# EasyEDA Pro project kuafu01_030内部老化方案.eprj, board PCB4 (continued)
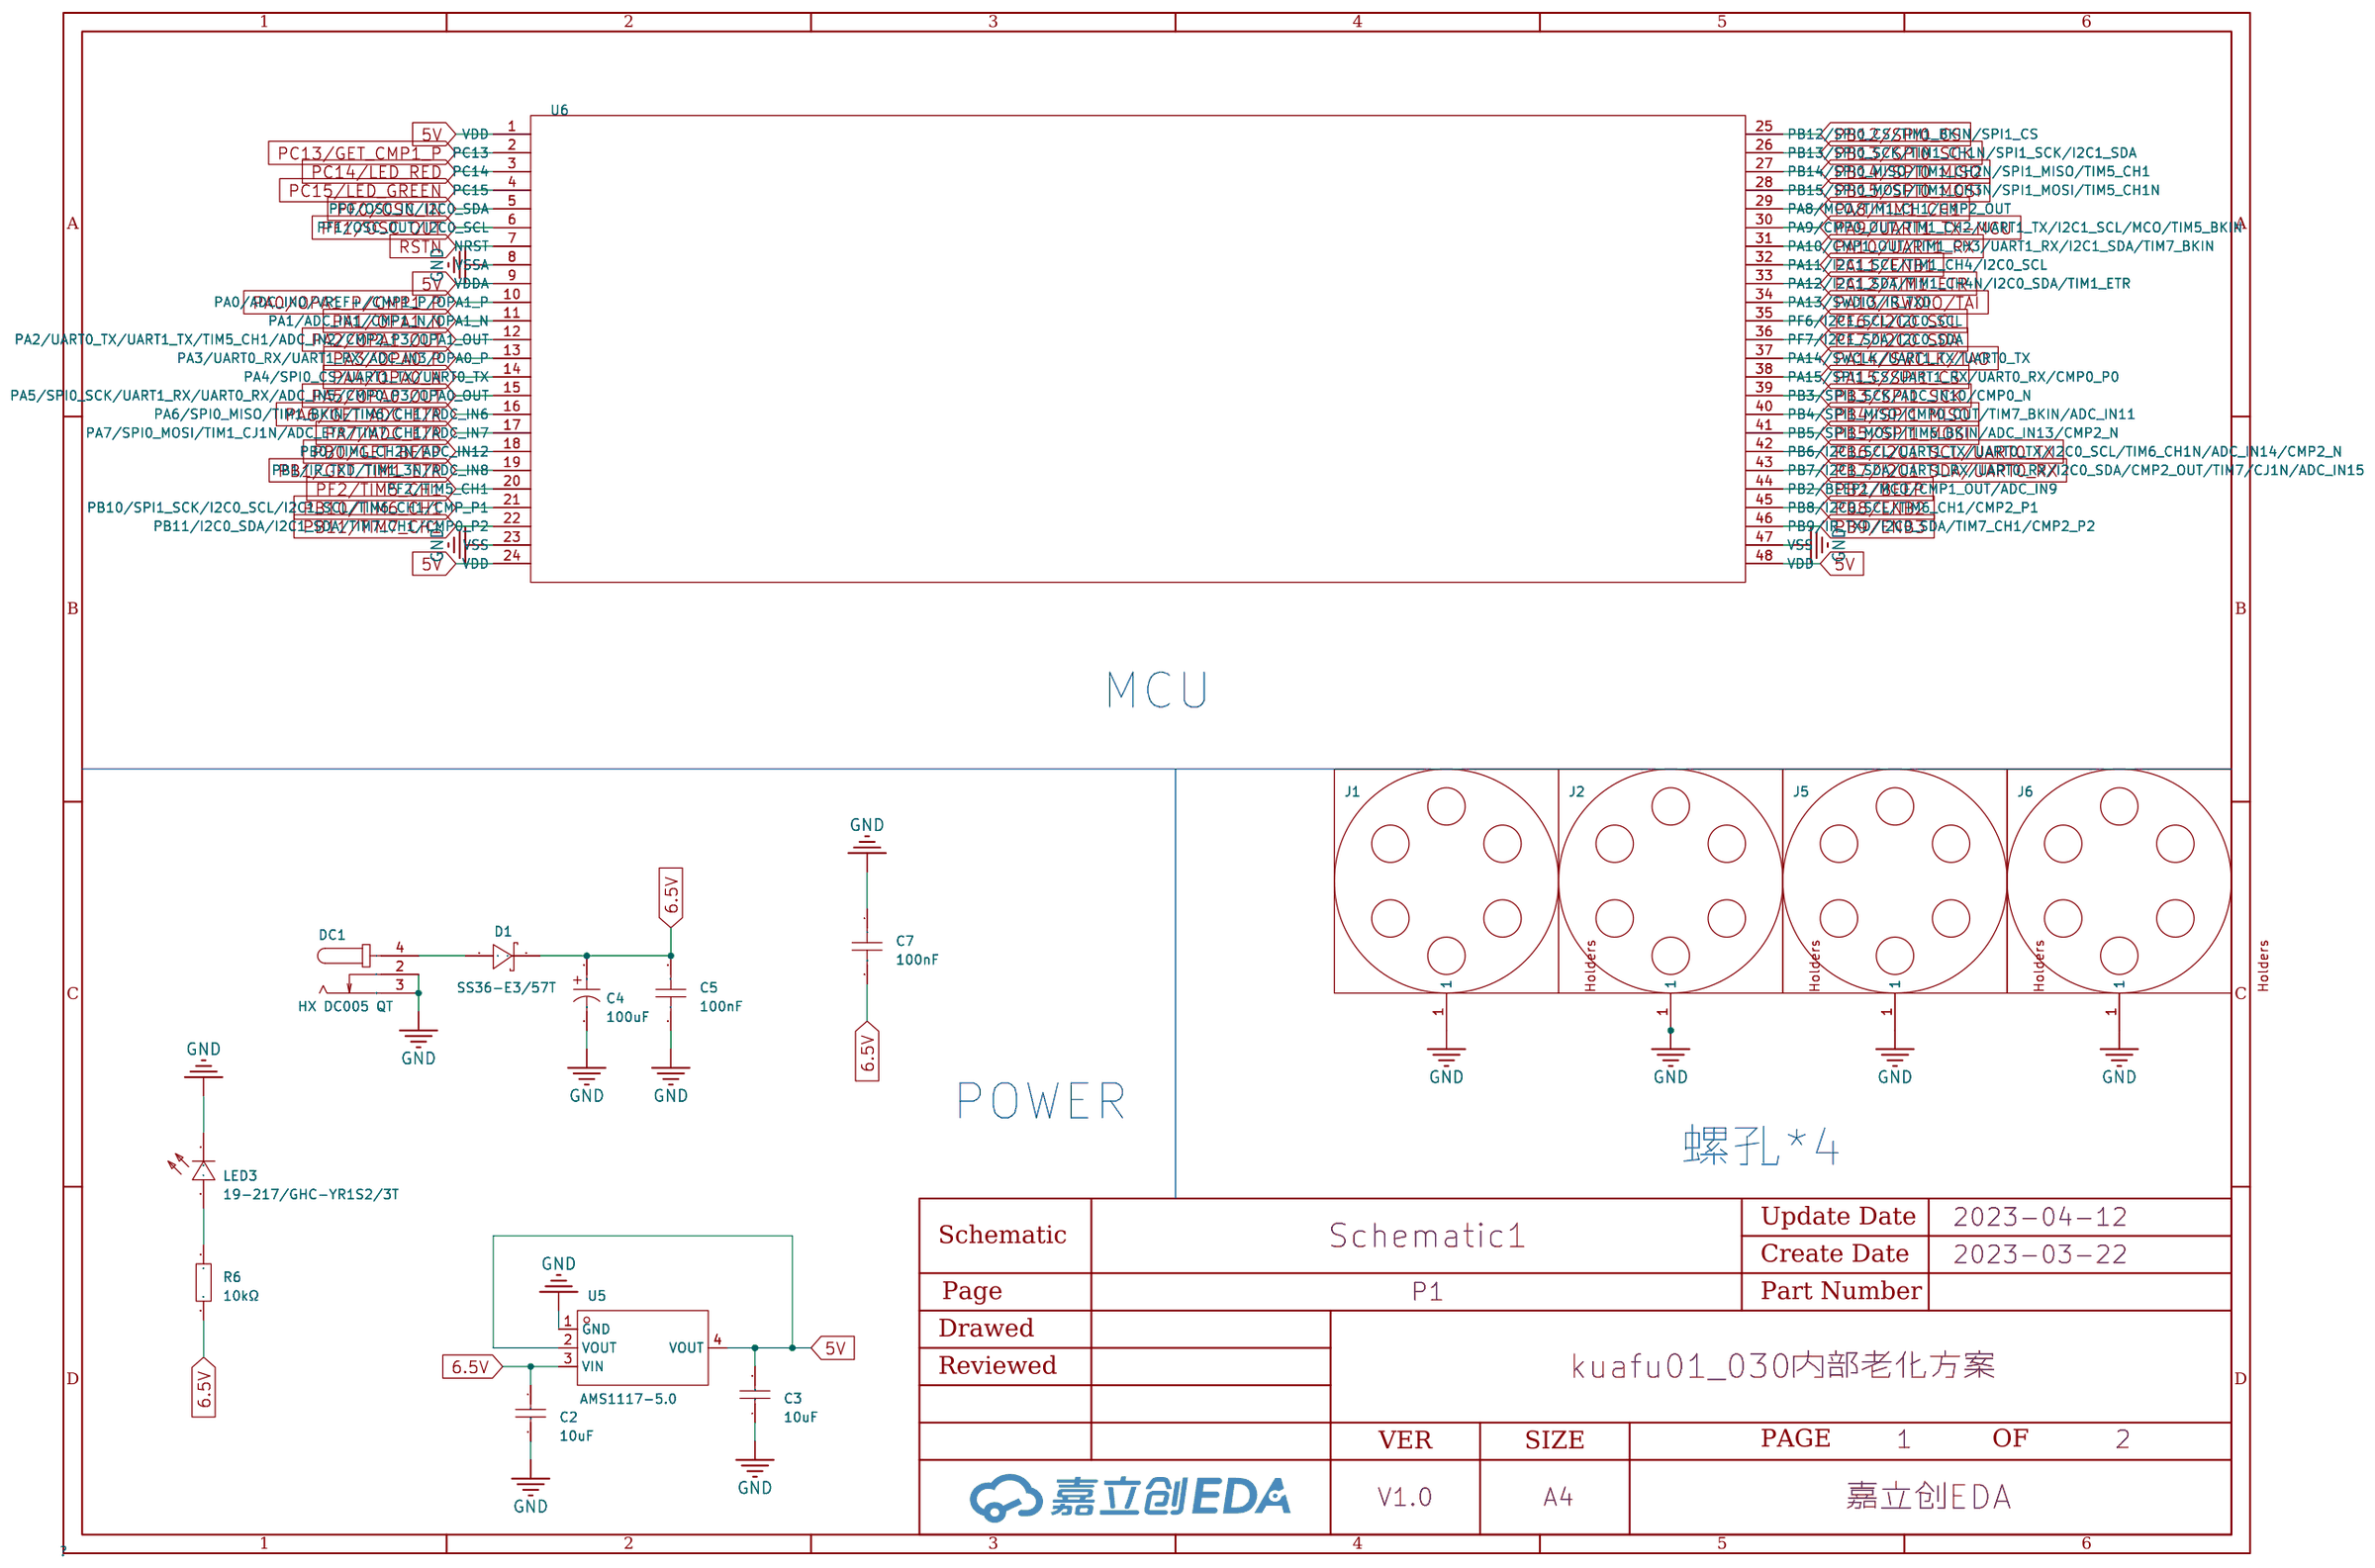
[diagram p0: P1]
## Routing (per net, layer and track width the routed paths; a pad name or vN(x,y) marks a point on that pad's centre or on a via; arc(x,y) is an arc through that point) (continued)
v1(113.79,267.46) v1(113.79,266.7) v1(113.79,256.54) v1(113.79,255.78) v1(113.79,255.02) v1(113.79,217.42) v1(113.79,216.66) v1(113.79,215.9) v1(113.79,205.74) v1(113.79,204.98) v1(113.79,204.22) v1(113.79,166.62) v1(113.79,165.86) v1(113.79,165.1) v1(113.79,154.94) v1(113.79,154.18) v1(113.79,153.42) v1(113.79,115.82) v1(113.79,115.06) v1(113.79,114.3) v1(113.79,104.14) v1(113.79,103.38) v1(113.79,102.62) v1(113.79,65.02) v1(113.79,64.26) v1(113.79,63.5) v1(113.79,53.34) v1(113.79,52.58) v1(113.79,51.82) v1(113.79,14.22) v1(113.79,13.46) v1(113.79,12.7) v1(114.55,358.14) v1(114.55,357.38) v1(114.55,356.62) v1(114.55,319.02) v1(114.55,318.26) v1(114.55,317.5) v1(114.55,307.34) v1(114.55,306.58) v1(114.55,305.82) v1(114.55,268.22) v1(114.55,267.46) v1(114.55,266.7) v1(114.55,256.54) v1(114.55,255.78) v1(114.55,255.02) v1(114.55,217.42) v1(114.55,216.66) v1(114.55,215.9) v1(114.55,205.74) v1(114.55,204.98) v1(114.55,204.22) v1(114.55,166.62) v1(114.55,165.86) v1(114.55,165.1) v1(114.55,154.94) v1(114.55,154.18) v1(114.55,153.42) v1(114.55,115.82) v1(114.55,115.06) v1(114.55,114.3) v1(114.55,104.14) v1(114.55,103.38) v1(114.55,102.62) v1(114.55,65.02) v1(114.55,64.26) v1(114.55,63.5) v1(114.55,53.34) v1(114.55,52.58) v1(114.55,51.82) v1(114.55,14.22) v1(114.55,13.46) v1(114.55,12.7) v1(115.32,358.14) v1(115.32,357.38) v1(115.32,356.62) v1(115.32,319.02) v1(115.32,318.26) v1(115.32,317.5) v1(115.32,307.34) v1(115.32,306.58) v1(115.32,305.82) v1(115.32,268.22) v1(115.32,267.46) v1(115.32,266.7) v1(115.32,256.54) v1(115.32,255.78) v1(115.32,255.02) v1(115.32,217.42) v1(115.32,216.66) v1(115.32,215.9) v1(115.32,205.74) v1(115.32,204.98) v1(115.32,204.22) v1(115.32,166.62) v1(115.32,165.86) v1(115.32,165.1) v1(115.32,154.94) v1(115.32,154.18) v1(115.32,153.42) v1(115.32,115.82) v1(115.32,115.06) v1(115.32,114.3) v1(115.32,104.14) v1(115.32,103.38) v1(115.32,102.62) v1(115.32,65.02) v1(115.32,64.26) v1(115.32,63.5) v1(115.32,53.34) v1(115.32,52.58) v1(115.32,51.82) v1(115.32,14.22) v1(115.32,13.46) v1(115.32,12.7) v1(116.33,352.04) v1(116.33,351.28) v1(116.33,350.52) v1(116.33,301.24) v1(116.33,300.48) v1(116.33,299.72) v1(116.33,250.44) v1(116.33,249.68) v1(116.33,248.92) v1(116.33,199.64) v1(116.33,198.88) v1(116.33,198.12) v1(116.33,148.84) v1(116.33,148.08) v1(116.33,147.32) v1(116.33,98.04) v1(116.33,97.28) v1(116.33,96.52) v1(116.33,47.24) v1(116.33,46.48) v1(116.33,45.72) v1(117.09,352.04) v1(117.09,351.28) v1(117.09,350.52) v1(117.09,301.24) v1(117.09,300.48) v1(117.09,299.72) v1(117.09,250.44) v1(117.09,249.68) v1(117.09,248.92) v1(117.09,199.64) v1(117.09,198.88) v1(117.09,198.12) v1(117.09,148.84) v1(117.09,148.08) v1(117.09,147.32) v1(117.09,98.04) v1(117.09,97.28) v1(117.09,96.52) v1(117.09,47.24) v1(117.09,46.48) v1(117.09,45.72) v1(117.86,352.04) v1(117.86,351.28) v1(117.86,350.52) v1(117.86,301.24) v1(117.86,300.48) v1(117.86,299.72) v1(117.86,250.44) v1(117.86,249.68) v1(117.86,248.92) v1(117.86,199.64) v1(117.86,198.88) v1(117.86,198.12) v1(117.86,148.84) v1(117.86,148.08) v1(117.86,147.32) v1(117.86,98.04) v1(117.86,97.28) v1(117.86,96.52) v1(117.86,47.24) v1(117.86,46.48) v1(117.86,45.72) v1(119.38,345.95) v1(119.38,345.19) v1(119.38,344.42) v1(119.38,323.6) v1(119.38,322.83) v1(119.38,322.07) v1(119.38,295.15) v1(119.38,294.39) v1(119.38,293.62) v1(119.38,272.8) v1(119.38,272.03) v1(119.38,271.27) v1(119.38,244.35) v1(119.38,243.59) v1(119.38,242.82) v1(119.38,222) v1(119.38,221.23) v1(119.38,220.47) v1(119.38,193.55) v1(119.38,192.79) v1(119.38,192.02) v1(119.38,171.2) v1(119.38,170.43) v1(119.38,169.67) v1(119.38,142.75) v1(119.38,141.99) v1(119.38,141.22) v1(119.38,120.4) v1(119.38,119.63) v1(119.38,118.87) v1(119.38,91.95) v1(119.38,91.19) v1(119.38,90.42) v1(119.38,69.6) v1(119.38,68.83) v1(119.38,68.07) v1(119.38,41.15) v1(119.38,40.39) v1(119.38,39.62) v1(119.38,18.8) v1(119.38,18.03) v1(119.38,17.27) v1(120.14,345.95) v1(120.14,345.19) v1(120.14,344.42) v1(120.14,323.6) v1(120.14,322.83) v1(120.14,322.07) v1(120.14,295.15) v1(120.14,294.39) v1(120.14,293.62) v1(120.14,272.8) v1(120.14,272.03) v1(120.14,271.27) v1(120.14,244.35) v1(120.14,243.59) v1(120.14,242.82) v1(120.14,222) v1(120.14,221.23) v1(120.14,220.47) v1(120.14,193.55) v1(120.14,192.79) v1(120.14,192.02) v1(120.14,171.2) v1(120.14,170.43) v1(120.14,169.67) v1(120.14,142.75) v1(120.14,141.99) v1(120.14,141.22) v1(120.14,120.4) v1(120.14,119.63) v1(120.14,118.87) v1(120.14,91.95) v1(120.14,91.19) v1(120.14,90.42) v1(120.14,69.6) v1(120.14,68.83) v1(120.14,68.07) v1(120.14,41.15) v1(120.14,40.39) v1(120.14,39.62) v1(120.14,18.8) v1(120.14,18.03) v1(120.14,17.27) v1(120.9,345.95) v1(120.9,345.19) v1(120.9,344.42) v1(120.9,323.6) v1(120.9,322.83) v1(120.9,322.07) v1(120.9,295.15) v1(120.9,294.39) v1(120.9,293.62) v1(120.9,272.8) v1(120.9,272.03) v1(120.9,271.27) v1(120.9,244.35) v1(120.9,243.59) v1(120.9,242.82) v1(120.9,222) v1(120.9,221.23) v1(120.9,220.47) v1(120.9,193.55) v1(120.9,192.79) v1(120.9,192.02) v1(120.9,171.2) v1(120.9,170.43) v1(120.9,169.67) v1(120.9,142.75) v1(120.9,141.99) v1(120.9,141.22) v1(120.9,120.4) v1(120.9,119.63) v1(120.9,118.87) v1(120.9,91.95) v1(120.9,91.19) v1(120.9,90.42) v1(120.9,69.6) v1(120.9,68.83) v1(120.9,68.07) v1(120.9,41.15) v1(120.9,40.39) v1(120.9,39.62) v1(120.9,18.8) v1(120.9,18.03) v1(120.9,17.27) v1(122.43,338.84) v1(122.43,338.07) v1(122.43,337.31) v1(122.43,329.18) v1(122.43,328.42) v1(122.43,327.66) v1(122.43,288.04) v1(122.43,287.27) v1(122.43,286.51) v1(122.43,278.38) v1(122.43,277.62) v1(122.43,276.86) v1(122.43,237.24) v1(122.43,236.47) v1(122.43,235.71) v1(122.43,227.58) v1(122.43,226.82) v1(122.43,226.06) v1(122.43,186.44) v1(122.43,185.67) v1(122.43,184.91) v1(122.43,176.78) v1(122.43,176.02) v1(122.43,175.26) v1(122.43,135.64) v1(122.43,134.87) v1(122.43,134.11) v1(122.43,125.98) v1(122.43,125.22) v1(122.43,124.46) v1(122.43,84.84) v1(122.43,84.07) v1(122.43,83.31) v1(122.43,75.18) v1(122.43,74.42) v1(122.43,73.66) v1(122.43,34.04) v1(122.43,33.27) v1(122.43,32.51) v1(122.43,24.38) v1(122.43,23.62) v1(122.43,22.86) v1(123.19,338.84) v1(123.19,338.07) v1(123.19,337.31) v1(123.19,329.18) v1(123.19,328.42) v1(123.19,327.66) v1(123.19,288.04) v1(123.19,287.27) v1(123.19,286.51) v1(123.19,278.38) v1(123.19,277.62) v1(123.19,276.86) v1(123.19,237.24) v1(123.19,236.47) v1(123.19,235.71) v1(123.19,227.58) v1(123.19,226.82) v1(123.19,226.06) v1(123.19,186.44) v1(123.19,185.67) v1(123.19,184.91) v1(123.19,176.78) v1(123.19,176.02) v1(123.19,175.26) v1(123.19,135.64) v1(123.19,134.87) v1(123.19,134.11) v1(123.19,125.98) v1(123.19,125.22) v1(123.19,124.46) v1(123.19,84.84) v1(123.19,84.07) v1(123.19,83.31) v1(123.19,75.18) v1(123.19,74.42) v1(123.19,73.66) v1(123.19,34.04) v1(123.19,33.27) v1(123.19,32.51) v1(123.19,24.38) v1(123.19,23.62) v1(123.19,22.86) v1(123.95,338.84) v1(123.95,338.07) v1(123.95,337.31) v1(123.95,329.18) v1(123.95,328.42) v1(123.95,327.66) v1(123.95,288.04) v1(123.95,287.27) v1(123.95,286.51) v1(123.95,278.38) v1(123.95,277.62) v1(123.95,276.86) v1(123.95,237.24) v1(123.95,236.47) v1(123.95,235.71) v1(123.95,227.58) v1(123.95,226.82) v1(123.95,226.06) v1(123.95,186.44) v1(123.95,185.67) v1(123.95,184.91) v1(123.95,176.78) v1(123.95,176.02) v1(123.95,175.26) v1(123.95,135.64) v1(123.95,134.87) v1(123.95,134.11) v1(123.95,125.98) v1(123.95,125.22) v1(123.95,124.46) v1(123.95,84.84) v1(123.95,84.07) v1(123.95,83.31) v1(123.95,75.18) v1(123.95,74.42) v1(123.95,73.66) v1(123.95,34.04) v1(123.95,33.27) v1(123.95,32.51) v1(123.95,24.38) v1(123.95,23.62) v1(123.95,22.86) v1(129.03,338.84) v1(129.03,338.07) v1(129.03,337.31) v1(129.03,332.74) v1(129.03,331.98) v1(129.03,331.22) v1(129.03,325.12) v1(129.03,324.36) v1(129.03,323.6) v1(129.03,288.04) v1(129.03,287.27) v1(129.03,286.51) v1(129.03,281.94) v1(129.03,281.18) v1(129.03,280.42) v1(129.03,274.32) v1(129.03,273.56) v1(129.03,272.8) v1(129.03,237.24) v1(129.03,236.47) v1(129.03,235.71) v1(129.03,231.14) v1(129.03,230.38) v1(129.03,229.62) v1(129.03,223.52) v1(129.03,222.76) v1(129.03,222) v1(129.03,186.44) v1(129.03,185.67) v1(129.03,184.91) v1(129.03,180.34) v1(129.03,179.58) v1(129.03,178.82) v1(129.03,172.72) v1(129.03,171.96) v1(129.03,171.2) v1(129.03,135.64) v1(129.03,134.87) v1(129.03,134.11) v1(129.03,129.54) v1(129.03,128.78) v1(129.03,128.02) v1(129.03,121.92) v1(129.03,121.16) v1(129.03,120.4) v1(129.03,84.84) v1(129.03,84.07) v1(129.03,83.31) v1(129.03,78.74) v1(129.03,77.98) v1(129.03,77.22) v1(129.03,71.12) v1(129.03,70.36) v1(129.03,69.6) v1(129.03,34.04) v1(129.03,33.27) v1(129.03,32.51) v1(129.03,27.94) v1(129.03,27.18) v1(129.03,26.42) v1(129.03,20.32) v1(129.03,19.56) v1(129.03,18.8) v1(129.79,338.84) v1(129.79,338.07) v1(129.79,337.31) v1(129.79,332.74) v1(129.79,331.98) v1(129.79,331.22) v1(129.79,325.12) v1(129.79,324.36) v1(129.79,323.6) v1(129.79,288.04) v1(129.79,287.27) v1(129.79,286.51) v1(129.79,281.94) v1(129.79,281.18) v1(129.79,280.42) v1(129.79,274.32) v1(129.79,273.56) v1(129.79,272.8) v1(129.79,237.24) v1(129.79,236.47) v1(129.79,235.71) v1(129.79,231.14) v1(129.79,230.38) v1(129.79,229.62) v1(129.79,223.52) v1(129.79,222.76) v1(129.79,222) v1(129.79,186.44) v1(129.79,185.67) v1(129.79,184.91) v1(129.79,180.34) v1(129.79,179.58) v1(129.79,178.82) v1(129.79,172.72) v1(129.79,171.96) v1(129.79,171.2) v1(129.79,135.64) v1(129.79,134.87) v1(129.79,134.11) v1(129.79,129.54) v1(129.79,128.78) v1(129.79,128.02) v1(129.79,121.92) v1(129.79,121.16) v1(129.79,120.4) v1(129.79,84.84) v1(129.79,84.07) v1(129.79,83.31) v1(129.79,78.74) v1(129.79,77.98) v1(129.79,77.22) v1(129.79,71.12) v1(129.79,70.36) v1(129.79,69.6) v1(129.79,34.04) v1(129.79,33.27) v1(129.79,32.51) v1(129.79,27.94) v1(129.79,27.18) v1(129.79,26.42) v1(129.79,20.32) v1(129.79,19.56) v1(129.79,18.8) v1(130.56,338.84) v1(130.56,338.07) v1(130.56,337.31) v1(130.56,332.74) v1(130.56,331.98) v1(130.56,331.22) v1(130.56,325.12) v1(130.56,324.36) v1(130.56,323.6) v1(130.56,288.04) v1(130.56,287.27) v1(130.56,286.51) v1(130.56,281.94) v1(130.56,281.18) v1(130.56,280.42) v1(130.56,274.32) v1(130.56,273.56) v1(130.56,272.8) v1(130.56,237.24) v1(130.56,236.47) v1(130.56,235.71) v1(130.56,231.14) v1(130.56,230.38) v1(130.56,229.62) v1(130.56,223.52) v1(130.56,222.76) v1(130.56,222) v1(130.56,186.44) v1(130.56,185.67) v1(130.56,184.91) v1(130.56,180.34) v1(130.56,179.58) v1(130.56,178.82) v1(130.56,172.72) v1(130.56,171.96) v1(130.56,171.2) v1(130.56,135.64) v1(130.56,134.87) v1(130.56,134.11) v1(130.56,129.54) v1(130.56,128.78) v1(130.56,128.02) v1(130.56,121.92) v1(130.56,121.16) v1(130.56,120.4) v1(130.56,84.84) v1(130.56,84.07) v1(130.56,83.31) v1(130.56,78.74) v1(130.56,77.98) v1(130.56,77.22) v1(130.56,71.12) v1(130.56,70.36) v1(130.56,69.6) v1(130.56,34.04) v1(130.56,33.27) v1(130.56,32.51) v1(130.56,27.94) v1(130.56,27.18) v1(130.56,26.42) v1(130.56,20.32) v1(130.56,19.56) v1(130.56,18.8) v1(131.06,345.95) v1(131.06,345.19) v1(131.06,344.42) v1(131.06,295.15) v1(131.06,294.39) v1(131.06,293.62) v1(131.06,244.35) v1(131.06,243.59) v1(131.06,242.82) v1(131.06,193.55) v1(131.06,192.79) v1(131.06,192.02) v1(131.06,142.75) v1(131.06,141.99) v1(131.06,141.22) v1(131.06,91.95) v1(131.06,91.19) v1(131.06,90.42) v1(131.06,41.15) v1(131.06,40.39) v1(131.06,39.62) v1(131.83,345.95) v1(131.83,345.19) v1(131.83,344.42) v1(131.83,295.15) v1(131.83,294.39) v1(131.83,293.62) v1(131.83,244.35) v1(131.83,243.59) v1(131.83,242.82) v1(131.83,193.55) v1(131.83,192.79) v1(131.83,192.02) v1(131.83,142.75) v1(131.83,141.99) v1(131.83,141.22) v1(131.83,91.95) v1(131.83,91.19) v1(131.83,90.42) v1(131.83,41.15) v1(131.83,40.39) v1(131.83,39.62) v1(132.59,352.04) v1(132.59,351.28) v1(132.59,350.52) v1(132.59,345.95) v1(132.59,345.19) v1(132.59,344.42) v1(132.59,301.24) v1(132.59,300.48) v1(132.59,299.72) v1(132.59,295.15) v1(132.59,294.39) v1(132.59,293.62) v1(132.59,250.44) v1(132.59,249.68) v1(132.59,248.92) v1(132.59,244.35) v1(132.59,243.59) v1(132.59,242.82) v1(132.59,199.64) v1(132.59,198.88) v1(132.59,198.12) v1(132.59,193.55) v1(132.59,192.79) v1(132.59,192.02) v1(132.59,148.84) v1(132.59,148.08) v1(132.59,147.32) v1(132.59,142.75) v1(132.59,141.99) v1(132.59,141.22) v1(132.59,98.04) v1(132.59,97.28) v1(132.59,96.52) v1(132.59,91.95) v1(132.59,91.19) v1(132.59,90.42) v1(132.59,47.24) v1(132.59,46.48) v1(132.59,45.72) v1(132.59,41.15) v1(132.59,40.39) v1(132.59,39.62) v1(133.35,352.04) v1(133.35,351.28) v1(133.35,350.52) v1(133.35,301.24) v1(133.35,300.48) v1(133.35,299.72) v1(133.35,250.44) v1(133.35,249.68) v1(133.35,248.92) v1(133.35,199.64) v1(133.35,198.88) v1(133.35,198.12) v1(133.35,148.84) v1(133.35,148.08) v1(133.35,147.32) v1(133.35,98.04) v1(133.35,97.28) v1(133.35,96.52) v1(133.35,47.24) v1(133.35,46.48) v1(133.35,45.72) v1(134.11,352.04) v1(134.11,351.28) v1(134.11,350.52) v1(134.11,301.24) v1(134.11,300.48) v1(134.11,299.72) v1(134.11,250.44) v1(134.11,249.68) v1(134.11,248.92) v1(134.11,199.64) v1(134.11,198.88) v1(134.11,198.12) v1(134.11,148.84) v1(134.11,148.08) v1(134.11,147.32) v1(134.11,98.04) v1(134.11,97.28) v1(134.11,96.52) v1(134.11,47.24) v1(134.11,46.48) v1(134.11,45.72) v1(134.62,358.14) v1(134.62,357.38) v1(134.62,356.62) v1(134.62,319.02) v1(134.62,318.26) v1(134.62,317.5) v1(134.62,307.34) v1(134.62,306.58) v1(134.62,305.82) v1(134.62,268.22) v1(134.62,267.46) v1(134.62,266.7) v1(134.62,256.54) v1(134.62,255.78) v1(134.62,255.02) v1(134.62,217.42) v1(134.62,216.66) v1(134.62,215.9) v1(134.62,205.74) v1(134.62,204.98) v1(134.62,204.22) v1(134.62,166.62) v1(134.62,165.86) v1(134.62,165.1) v1(134.62,154.94) v1(134.62,154.18) v1(134.62,153.42) v1(134.62,115.82) v1(134.62,115.06) v1(134.62,114.3) v1(134.62,104.14) v1(134.62,103.38) v1(134.62,102.62) v1(134.62,65.02) v1(134.62,64.26) v1(134.62,63.5) v1(134.62,53.34) v1(134.62,52.58) v1(134.62,51.82) v1(134.62,14.22) v1(134.62,13.46) v1(134.62,12.7) v1(135.38,358.14) v1(135.38,357.38) v1(135.38,356.62) v1(135.38,319.02) v1(135.38,318.26) v1(135.38,317.5) v1(135.38,307.34) v1(135.38,306.58) v1(135.38,305.82) v1(135.38,268.22) v1(135.38,267.46) v1(135.38,266.7) v1(135.38,256.54) v1(135.38,255.78) v1(135.38,255.02) v1(135.38,217.42) v1(135.38,216.66) v1(135.38,215.9) v1(135.38,205.74) v1(135.38,204.98) v1(135.38,204.22) v1(135.38,166.62) v1(135.38,165.86) v1(135.38,165.1) v1(135.38,154.94) v1(135.38,154.18) v1(135.38,153.42) v1(135.38,115.82) v1(135.38,115.06) v1(135.38,114.3) v1(135.38,104.14) v1(135.38,103.38) v1(135.38,102.62) v1(135.38,65.02) v1(135.38,64.26) v1(135.38,63.5) v1(135.38,53.34) v1(135.38,52.58) v1(135.38,51.82) v1(135.38,14.22) v1(135.38,13.46) v1(135.38,12.7) v1(136.14,358.14) v1(136.14,357.38) v1(136.14,356.62) v1(136.14,319.02) v1(136.14,318.26) v1(136.14,317.5) v1(136.14,307.34) v1(136.14,306.58) v1(136.14,305.82) v1(136.14,268.22) v1(136.14,267.46) v1(136.14,266.7) v1(136.14,256.54) v1(136.14,255.78) v1(136.14,255.02) v1(136.14,217.42) v1(136.14,216.66) v1(136.14,215.9) v1(136.14,205.74) v1(136.14,204.98) v1(136.14,204.22) v1(136.14,166.62) v1(136.14,165.86) v1(136.14,165.1) v1(136.14,154.94) v1(136.14,154.18) v1(136.14,153.42) v1(136.14,115.82) v1(136.14,115.06) v1(136.14,114.3) v1(136.14,104.14) v1(136.14,103.38) v1(136.14,102.62) v1(136.14,65.02) v1(136.14,64.26) v1(136.14,63.5) v1(136.14,53.34) v1(136.14,52.58) v1(136.14,51.82) v1(136.14,14.22) v1(136.14,13.46) v1(136.14,12.7) v1(164.59,358.14) v1(164.59,357.38) v1(164.59,356.62) v1(164.59,319.02) v1(164.59,318.26) v1(164.59,317.5) v1(164.59,307.34) v1(164.59,306.58) v1(164.59,305.82) v1(164.59,268.22) v1(164.59,267.46) v1(164.59,266.7) v1(164.59,256.54) v1(164.59,255.78) v1(164.59,255.02) v1(164.59,217.42) v1(164.59,216.66) v1(164.59,215.9) v1(164.59,205.74) v1(164.59,204.98) v1(164.59,204.22) v1(164.59,166.62) v1(164.59,165.86) v1(164.59,165.1) v1(164.59,154.94) v1(164.59,154.18) v1(164.59,153.42) v1(164.59,115.82) v1(164.59,115.06) v1(164.59,114.3) v1(164.59,104.14) v1(164.59,103.38) v1(164.59,102.62) v1(164.59,65.02) v1(164.59,64.26) v1(164.59,63.5) v1(164.59,53.34) v1(164.59,52.58) v1(164.59,51.82) v1(164.59,14.22) v1(164.59,13.46) v1(164.59,12.7) v1(165.35,358.14) v1(165.35,357.38) v1(165.35,356.62) v1(165.35,319.02) v1(165.35,318.26) v1(165.35,317.5) v1(165.35,307.34) v1(165.35,306.58) v1(165.35,305.82) v1(165.35,268.22) v1(165.35,267.46) v1(165.35,266.7) v1(165.35,256.54) v1(165.35,255.78) v1(165.35,255.02) v1(165.35,217.42) v1(165.35,216.66) v1(165.35,215.9) v1(165.35,205.74) v1(165.35,204.98) v1(165.35,204.22) v1(165.35,166.62) v1(165.35,165.86) v1(165.35,165.1) v1(165.35,154.94) v1(165.35,154.18) v1(165.35,153.42) v1(165.35,115.82) v1(165.35,115.06) v1(165.35,114.3) v1(165.35,104.14) v1(165.35,103.38) v1(165.35,102.62) v1(165.35,65.02) v1(165.35,64.26) v1(165.35,63.5) v1(165.35,53.34) v1(165.35,52.58) v1(165.35,51.82) v1(165.35,14.22) v1(165.35,13.46) v1(165.35,12.7) v1(166.12,358.14) v1(166.12,357.38) v1(166.12,356.62) v1(166.12,319.02) v1(166.12,318.26) v1(166.12,317.5) v1(166.12,307.34) v1(166.12,306.58) v1(166.12,305.82) v1(166.12,268.22) v1(166.12,267.46) v1(166.12,266.7) v1(166.12,256.54) v1(166.12,255.78) v1(166.12,255.02) v1(166.12,217.42) v1(166.12,216.66) v1(166.12,215.9) v1(166.12,205.74) v1(166.12,204.98) v1(166.12,204.22) v1(166.12,166.62) v1(166.12,165.86) v1(166.12,165.1) v1(166.12,154.94) v1(166.12,154.18) v1(166.12,153.42) v1(166.12,115.82) v1(166.12,115.06) v1(166.12,114.3) v1(166.12,104.14) v1(166.12,103.38) v1(166.12,102.62) v1(166.12,65.02) v1(166.12,64.26) v1(166.12,63.5) v1(166.12,53.34) v1(166.12,52.58) v1(166.12,51.82) v1(166.12,14.22) v1(166.12,13.46) v1(166.12,12.7) v1(167.13,352.04) v1(167.13,351.28) v1(167.13,350.52) v1(167.13,301.24) v1(167.13,300.48) v1(167.13,299.72) v1(167.13,250.44) v1(167.13,249.68) v1(167.13,248.92) v1(167.13,199.64) v1(167.13,198.88) v1(167.13,198.12) v1(167.13,148.84) v1(167.13,148.08) v1(167.13,147.32) v1(167.13,98.04) v1(167.13,97.28) v1(167.13,96.52) v1(167.13,47.24) v1(167.13,46.48) v1(167.13,45.72) v1(167.89,352.04) v1(167.89,351.28) v1(167.89,350.52) v1(167.89,301.24) v1(167.89,300.48) v1(167.89,299.72) v1(167.89,250.44) v1(167.89,249.68) v1(167.89,248.92) v1(167.89,199.64) v1(167.89,198.88) v1(167.89,198.12) v1(167.89,148.84) v1(167.89,148.08) v1(167.89,147.32) v1(167.89,98.04) v1(167.89,97.28) v1(167.89,96.52) v1(167.89,47.24) v1(167.89,46.48) v1(167.89,45.72) v1(168.66,352.04) v1(168.66,351.28) v1(168.66,350.52) v1(168.66,301.24) v1(168.66,300.48) v1(168.66,299.72) v1(168.66,250.44) v1(168.66,249.68) v1(168.66,248.92) v1(168.66,199.64) v1(168.66,198.88) v1(168.66,198.12) v1(168.66,148.84) v1(168.66,148.08) v1(168.66,147.32) v1(168.66,98.04) v1(168.66,97.28) v1(168.66,96.52) v1(168.66,47.24) v1(168.66,46.48) v1(168.66,45.72) v1(170.18,345.95) v1(170.18,345.19) v1(170.18,344.42) v1(170.18,323.6) v1(170.18,322.83) v1(170.18,322.07) v1(170.18,295.15) v1(170.18,294.39) v1(170.18,293.62) v1(170.18,272.8) v1(170.18,272.03) v1(170.18,271.27) v1(170.18,244.35) v1(170.18,243.59) v1(170.18,242.82) v1(170.18,222) v1(170.18,221.23) v1(170.18,220.47) v1(170.18,193.55) v1(170.18,192.79) v1(170.18,192.02) v1(170.18,171.2) v1(170.18,170.43) v1(170.18,169.67) v1(170.18,142.75) v1(170.18,141.99) v1(170.18,141.22) v1(170.18,120.4) v1(170.18,119.63) v1(170.18,118.87) v1(170.18,91.95) v1(170.18,91.19) v1(170.18,90.42) v1(170.18,69.6) v1(170.18,68.83) v1(170.18,68.07) v1(170.18,41.15) v1(170.18,40.39) v1(170.18,39.62) v1(170.18,18.8) v1(170.18,18.03) v1(170.18,17.27) v1(170.94,345.95) v1(170.94,345.19) v1(170.94,344.42) v1(170.94,323.6) v1(170.94,322.83) v1(170.94,322.07) v1(170.94,295.15) v1(170.94,294.39) v1(170.94,293.62) v1(170.94,272.8) v1(170.94,272.03) v1(170.94,271.27) v1(170.94,244.35) v1(170.94,243.59) v1(170.94,242.82) v1(170.94,222) v1(170.94,221.23) v1(170.94,220.47) v1(170.94,193.55) v1(170.94,192.79) v1(170.94,192.02) v1(170.94,171.2) v1(170.94,170.43) v1(170.94,169.67) v1(170.94,142.75) v1(170.94,141.99) v1(170.94,141.22) v1(170.94,120.4) v1(170.94,119.63) v1(170.94,118.87) v1(170.94,91.95) v1(170.94,91.19) v1(170.94,90.42) v1(170.94,69.6) 